# Altium schematic sheet 0229_GPU_ USB & RSVD.SchDoc
size 848 x 558 mm
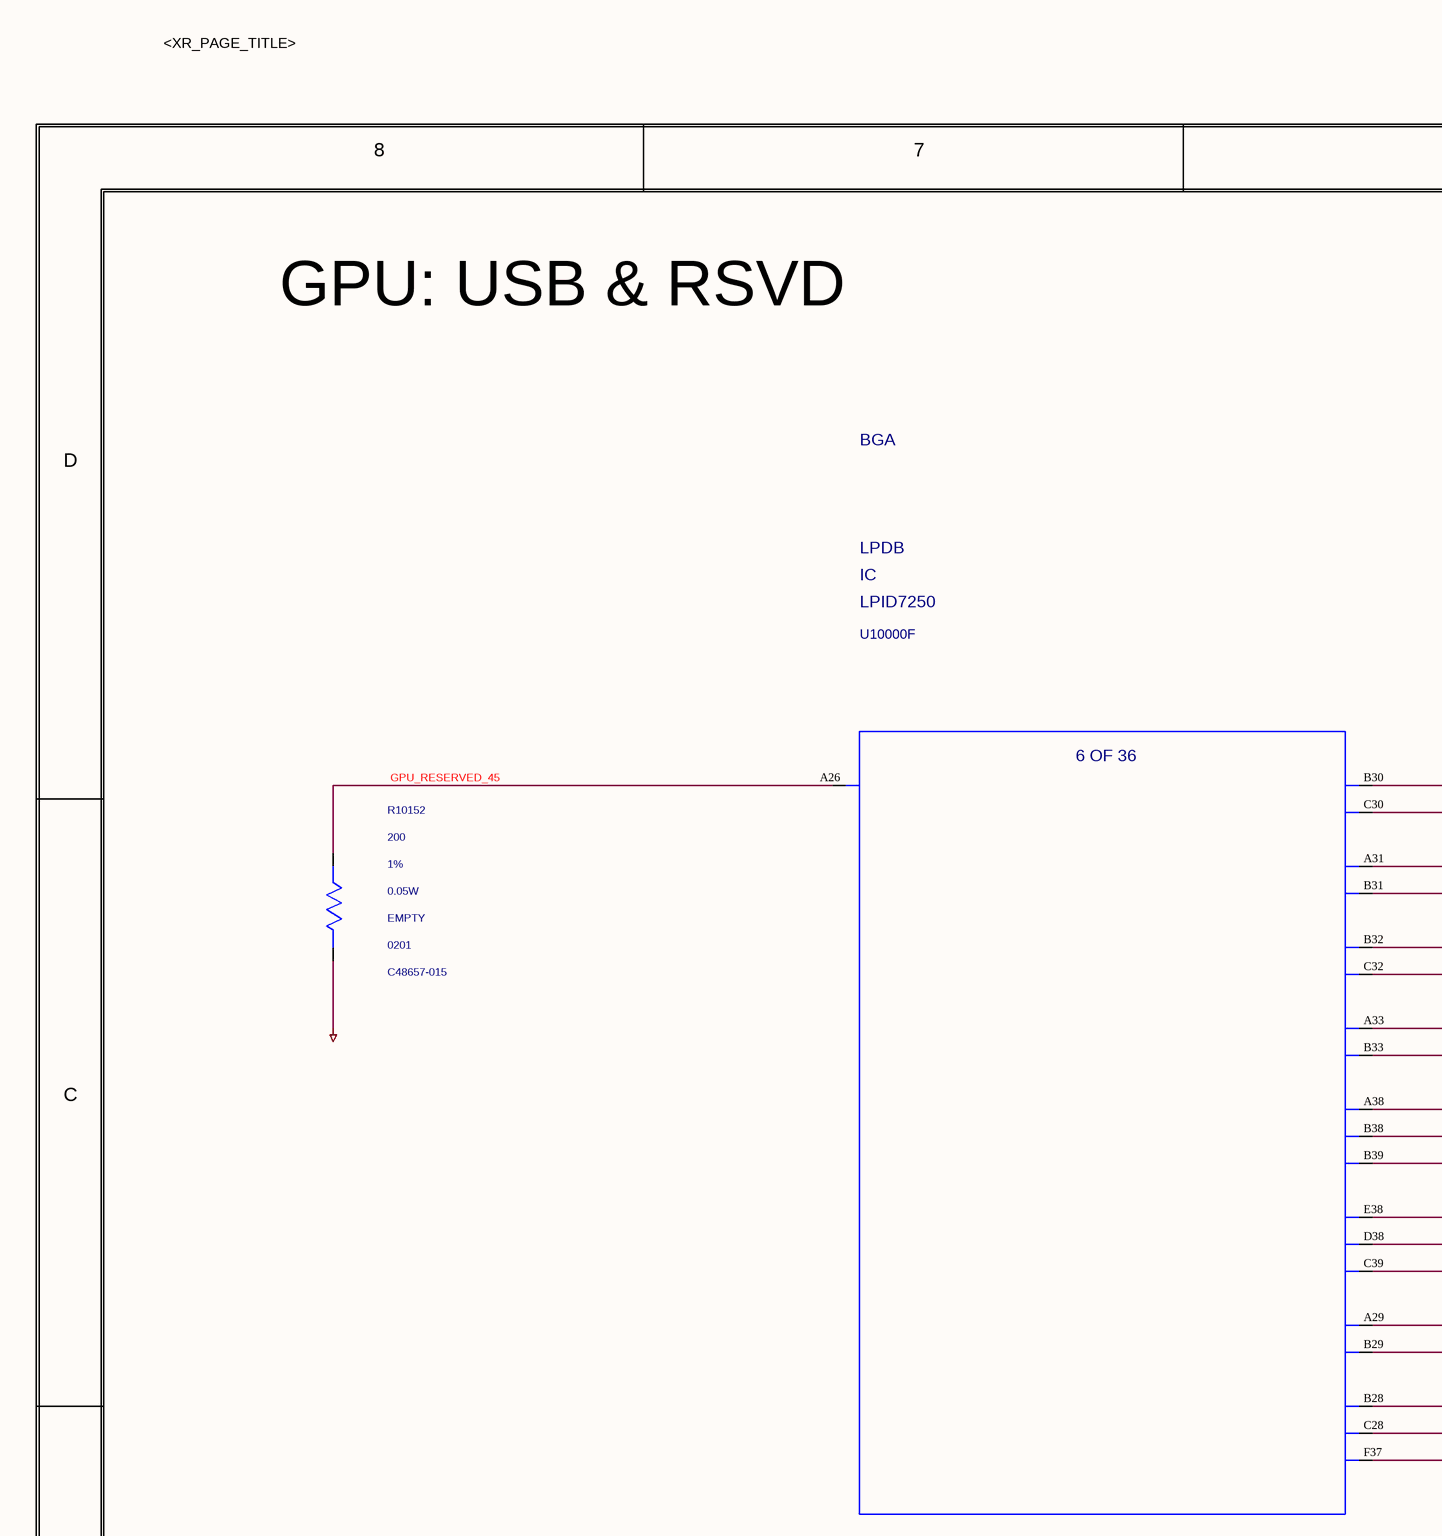
[diagram p0: 0229_GPU_ USB & RSVD.SchDoc, top left]
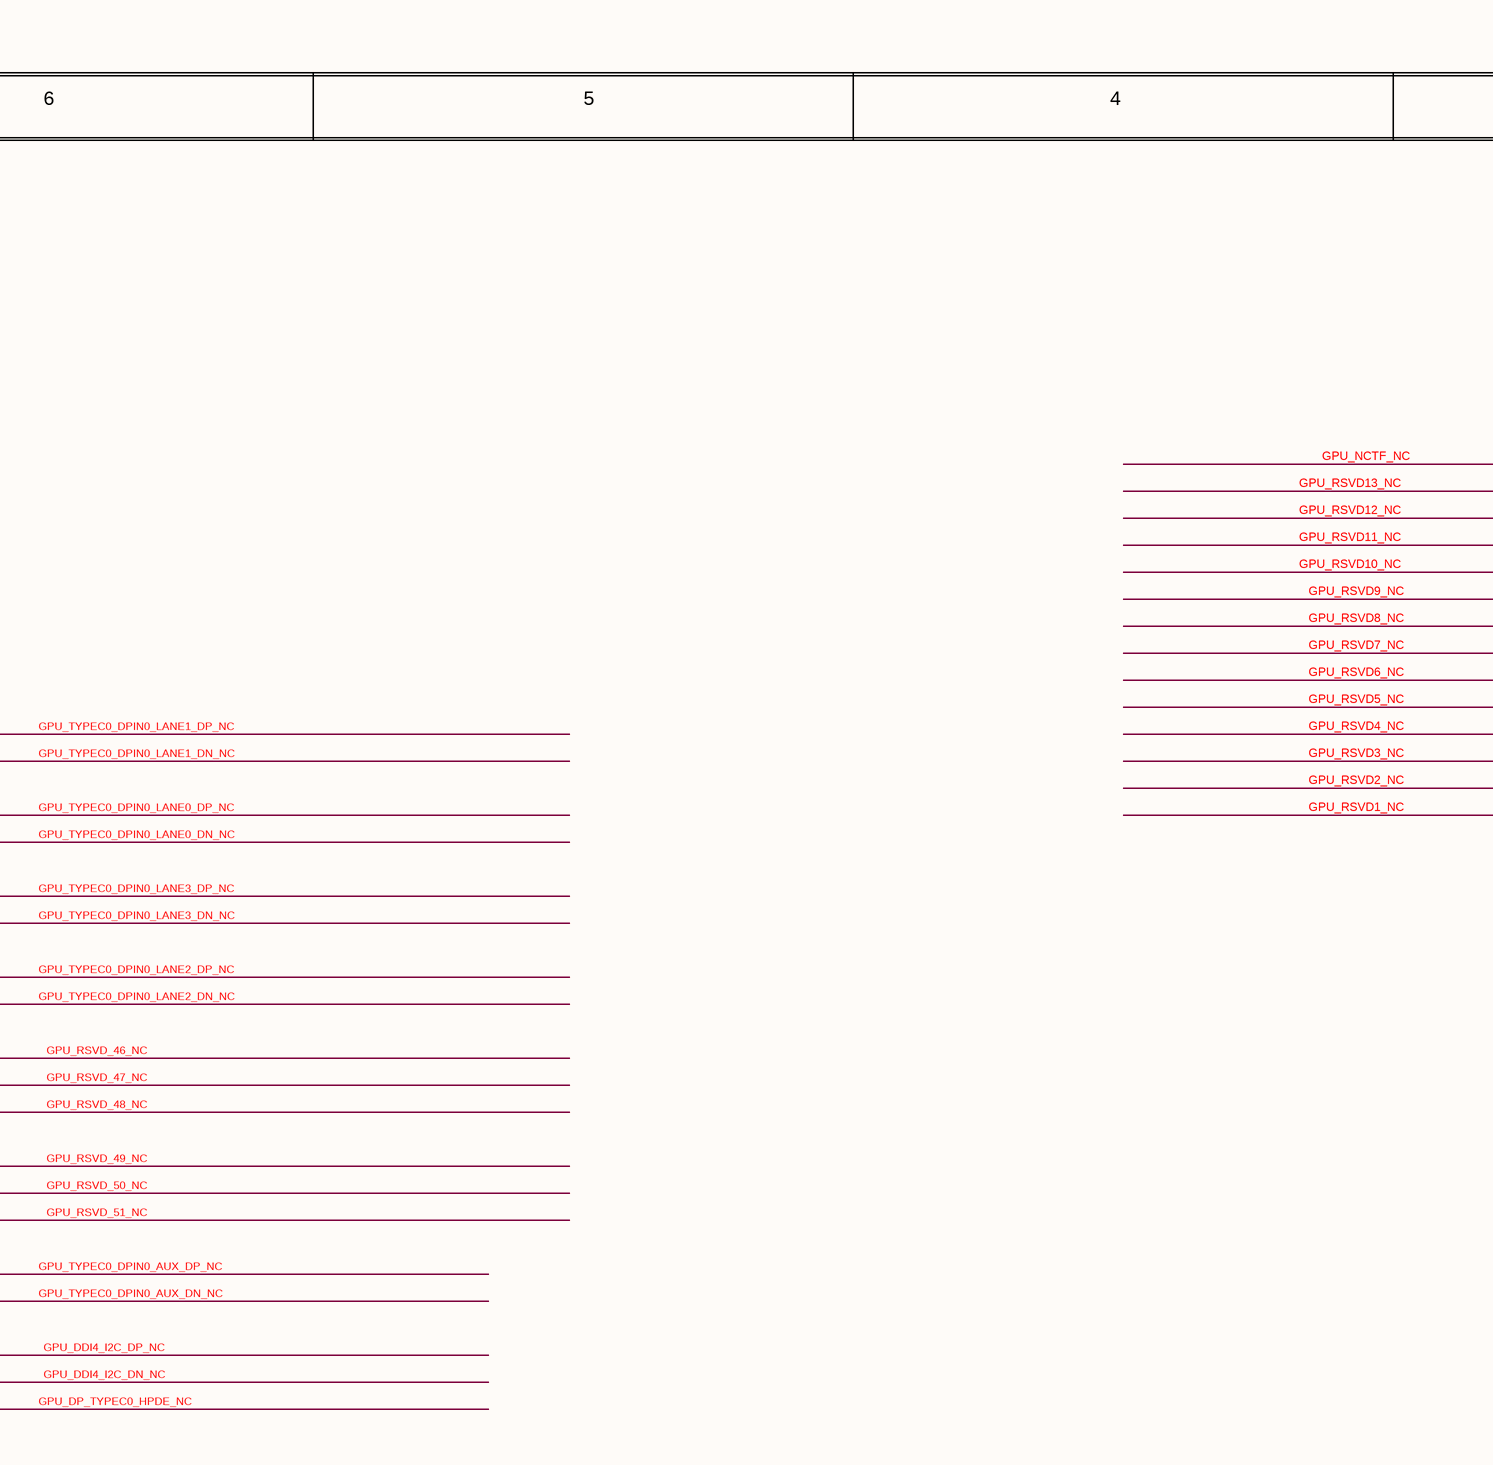
[diagram p1: 0229_GPU_ USB & RSVD.SchDoc, top middle]
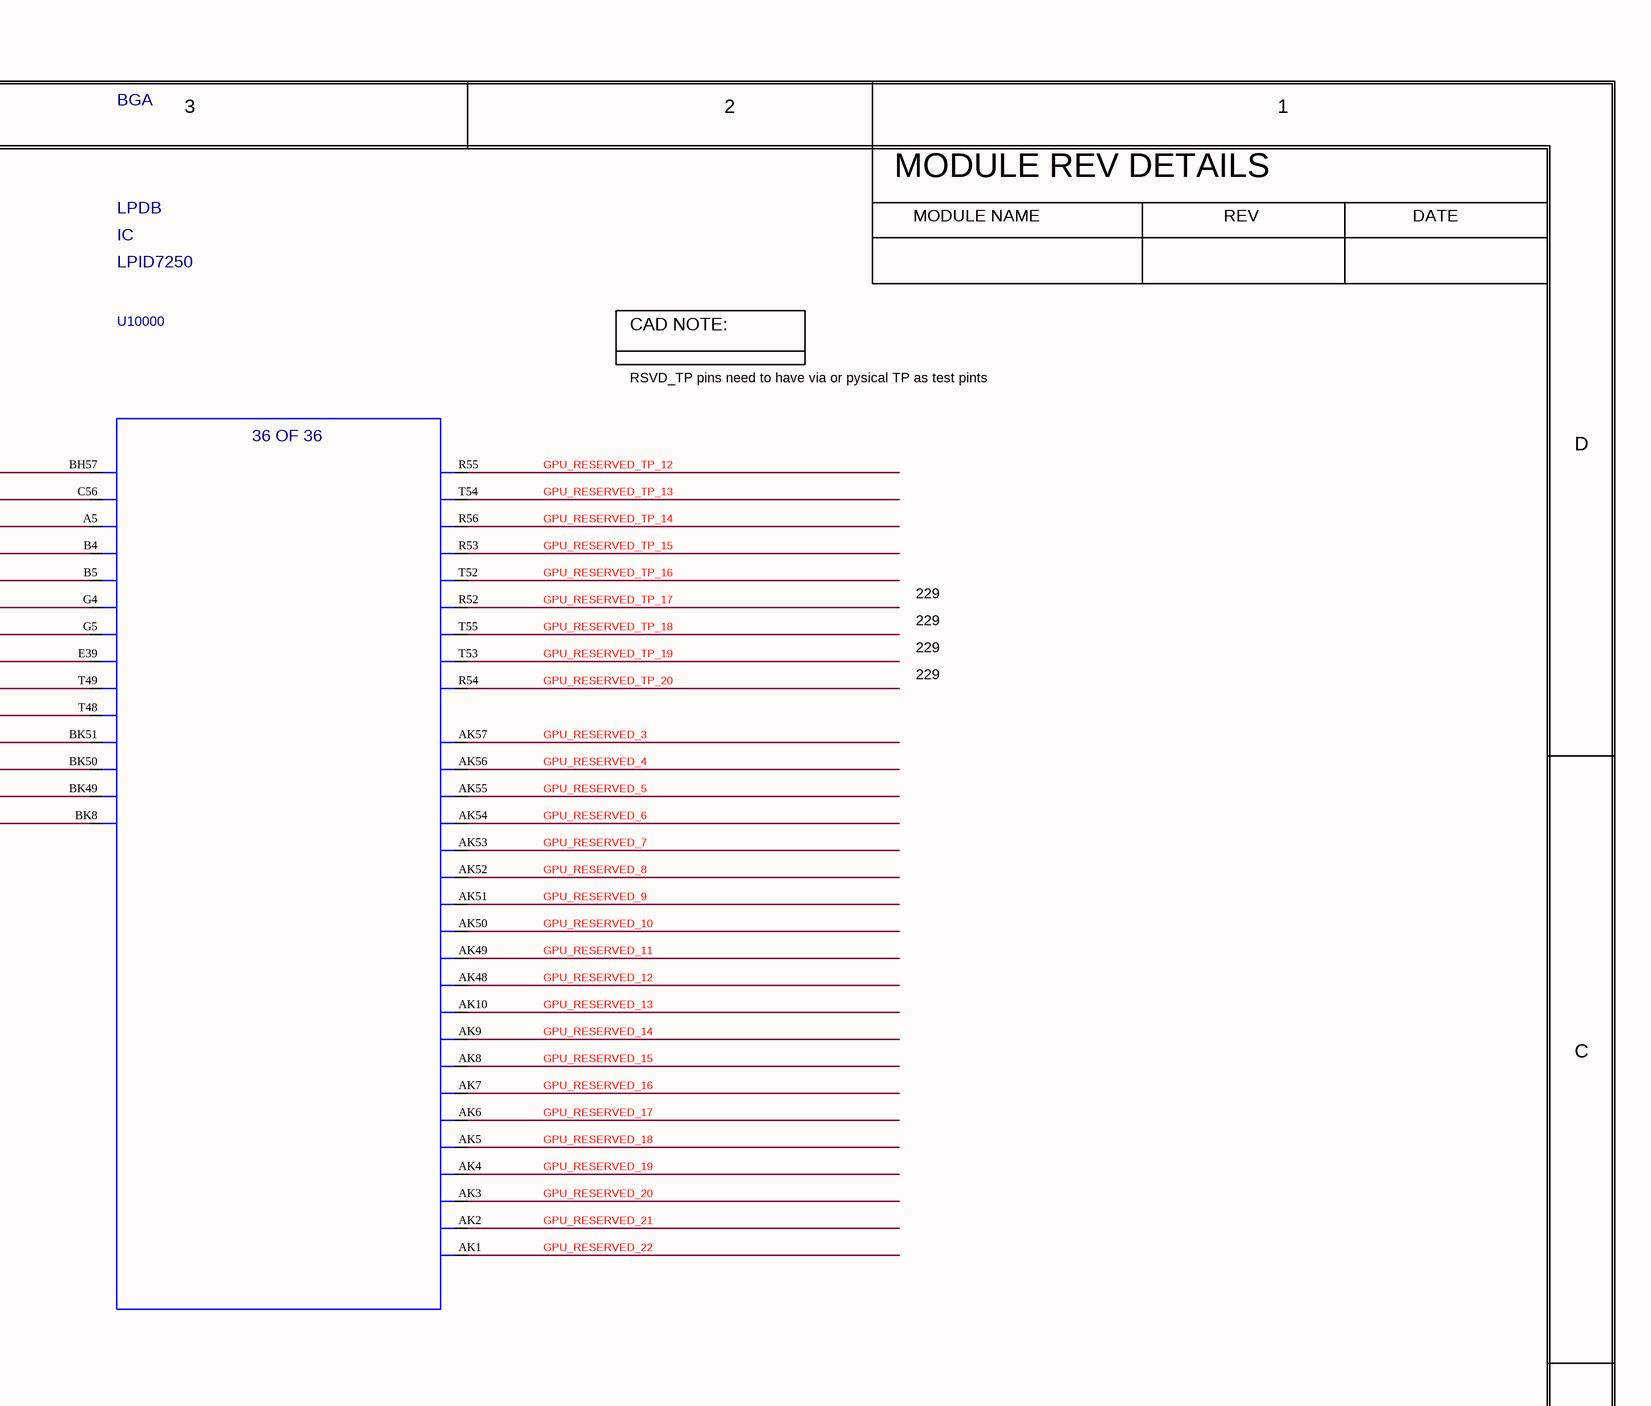
[diagram p2: 0229_GPU_ USB & RSVD.SchDoc, top right]
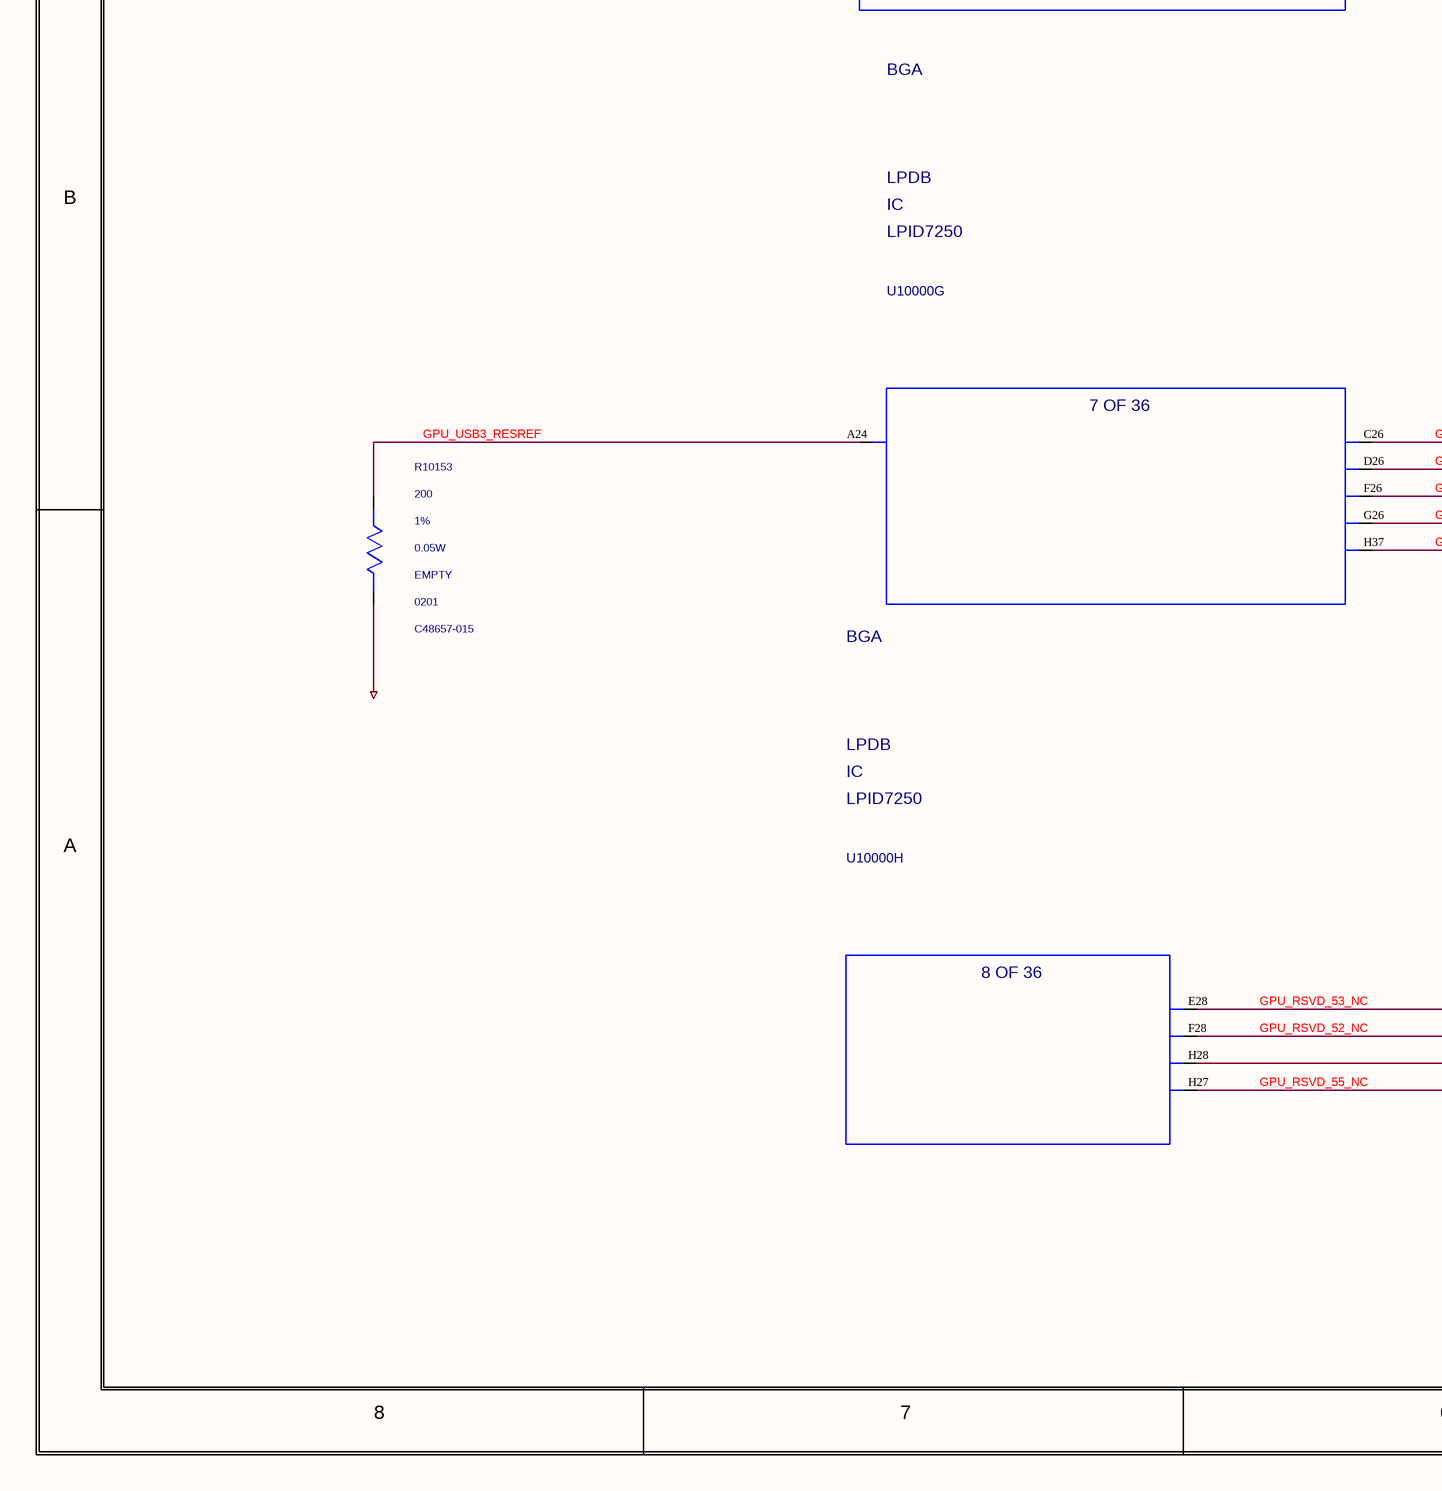
[diagram p3: 0229_GPU_ USB & RSVD.SchDoc, bottom left]
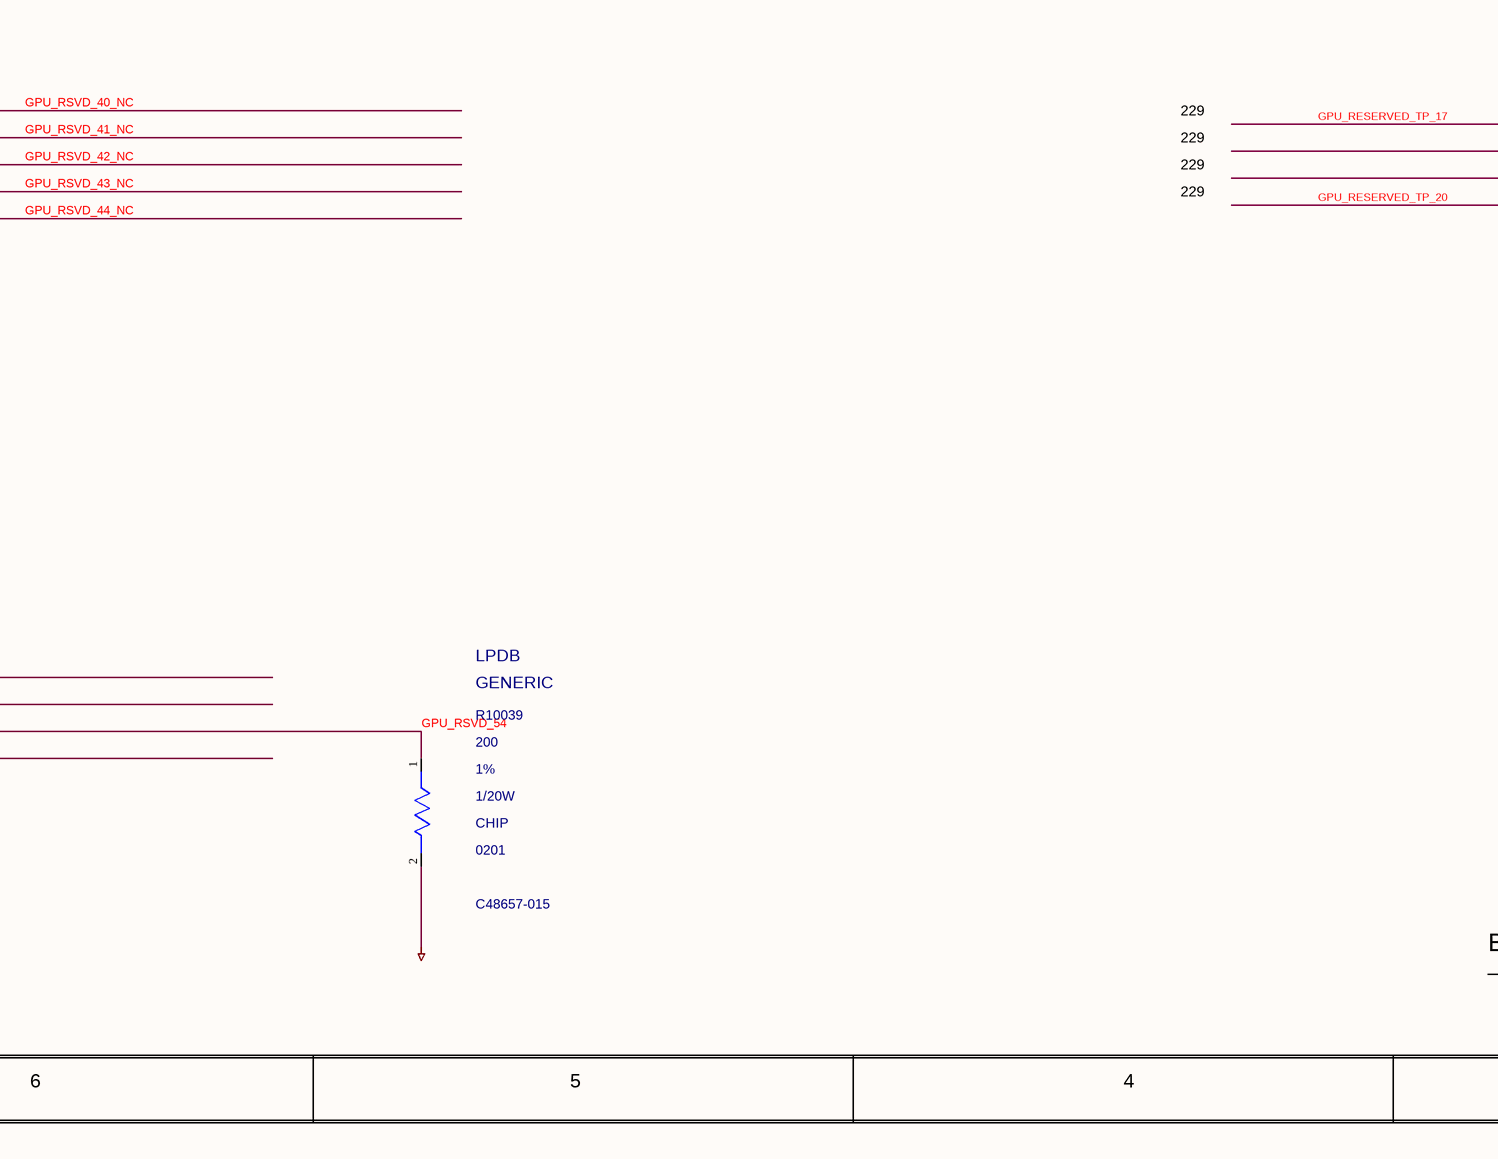
[diagram p4: 0229_GPU_ USB & RSVD.SchDoc, bottom middle]
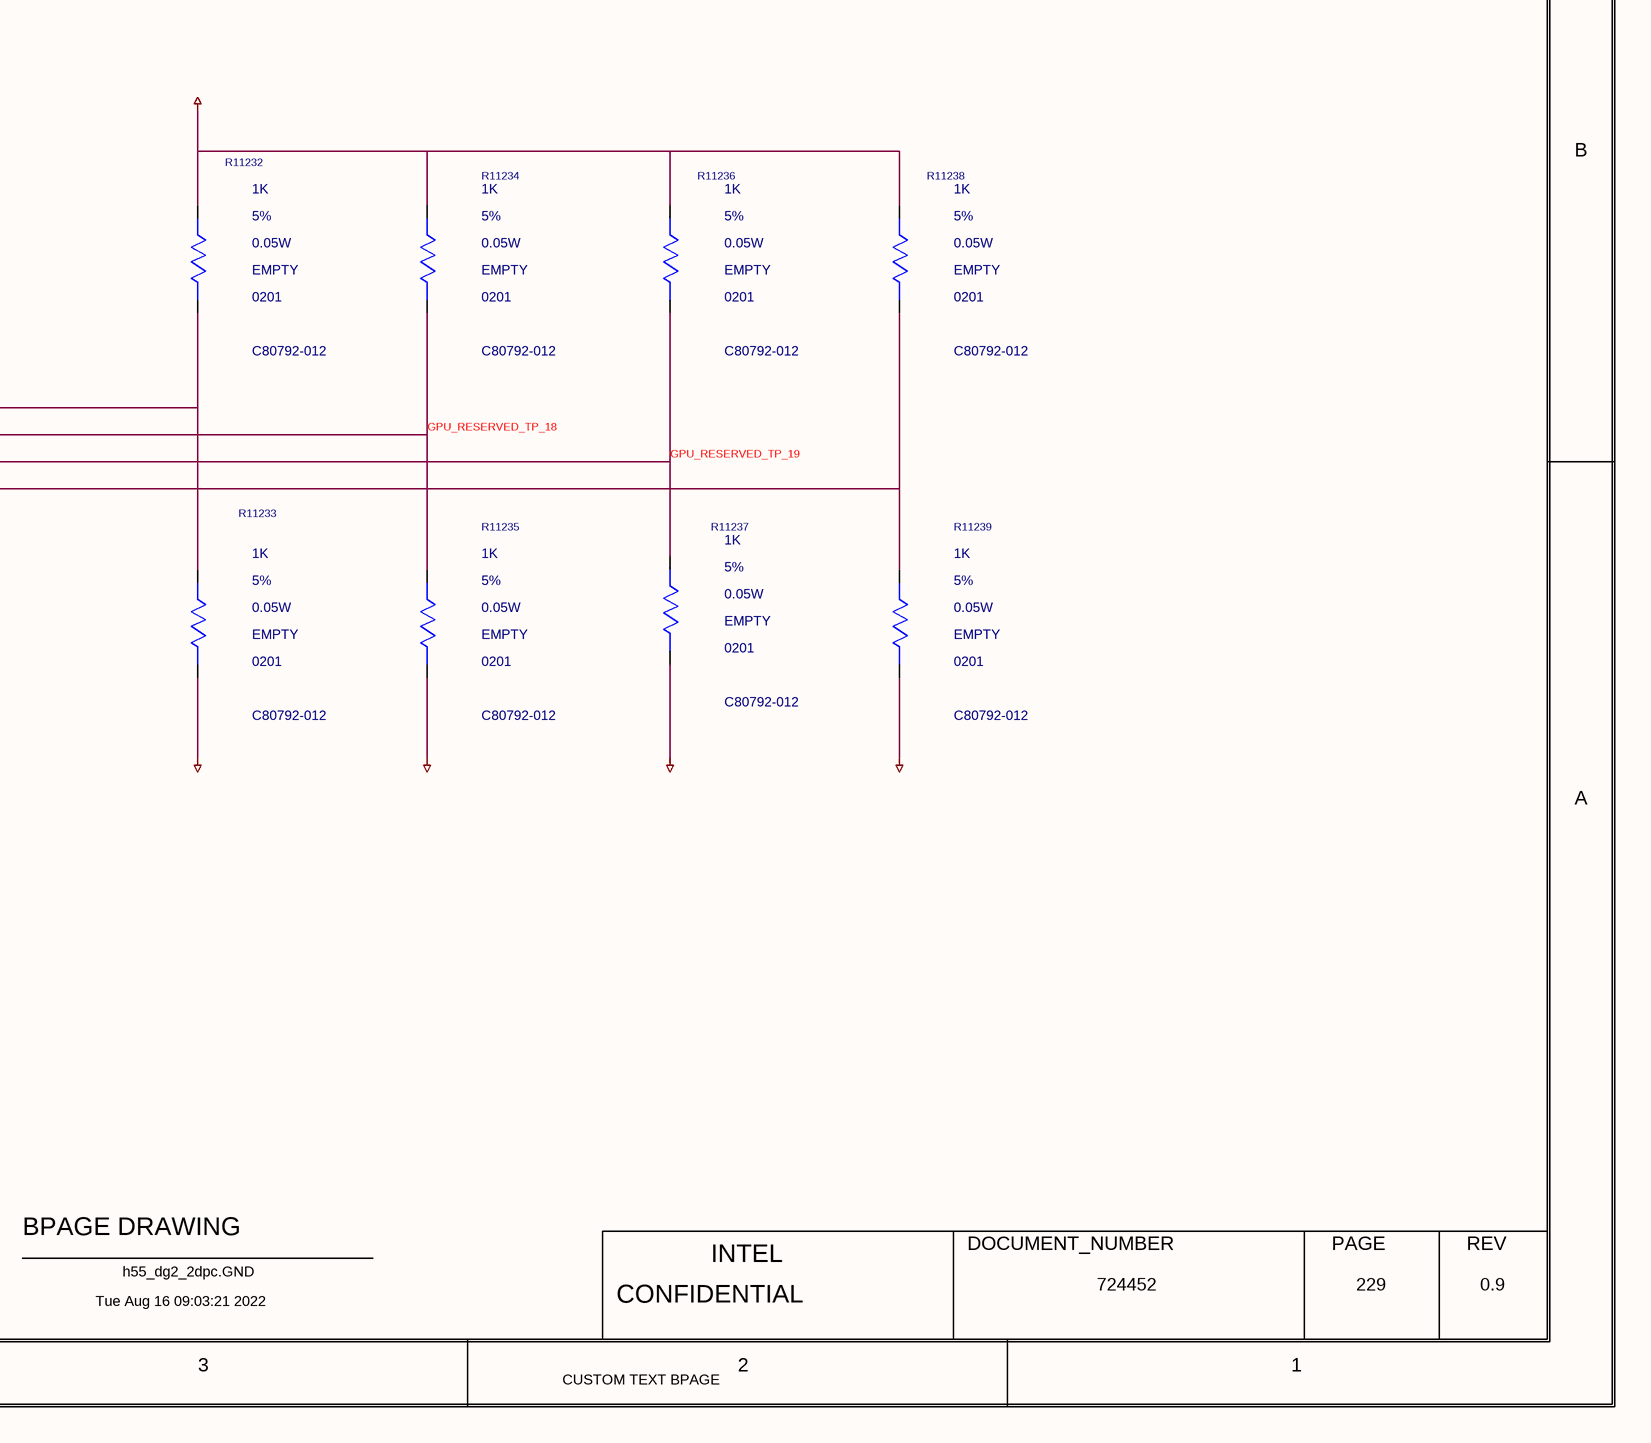
[diagram p5: 0229_GPU_ USB & RSVD.SchDoc, bottom right]

## Parts
R10039  200  MATERIAL: CHIP  PACK_TYPE: 0201  PART_NUMBER: C48657-015  TOLERANCE: 1%  WATTAGE: 1/20W  IP: GENERIC  FP_TECH: LPDB  [SMR0201IA]
R10152  200  MATERIAL: EMPTY  PACK_TYPE: 0201  PART_NUMBER: C48657-015  TOLERANCE: 1%  WATTAGE: 0.05W  [CTK0_SM0201_650X350_MA]
R10153  200  MATERIAL: EMPTY  PACK_TYPE: 0201  PART_NUMBER: C48657-015  TOLERANCE: 1%  WATTAGE: 0.05W  [CTK0_SM0201_650X350_MA]
R11232  1K  MATERIAL: EMPTY  PACK_TYPE: 0201  PART_NUMBER: C80792-012  TOLERANCE: 5%  WATTAGE: 0.05W  [TK0_SM0201_630X330_MC]
R11233  1K  MATERIAL: EMPTY  PACK_TYPE: 0201  PART_NUMBER: C80792-012  TOLERANCE: 5%  WATTAGE: 0.05W  [TK0_SM0201_630X330_MC]
R11234  1K  MATERIAL: EMPTY  PACK_TYPE: 0201  PART_NUMBER: C80792-012  TOLERANCE: 5%  WATTAGE: 0.05W  [TK0_SM0201_630X330_MC]
R11235  1K  MATERIAL: EMPTY  PACK_TYPE: 0201  PART_NUMBER: C80792-012  TOLERANCE: 5%  WATTAGE: 0.05W  [TK0_SM0201_630X330_MC]
R11236  1K  MATERIAL: EMPTY  PACK_TYPE: 0201  PART_NUMBER: C80792-012  TOLERANCE: 5%  WATTAGE: 0.05W  [TK0_SM0201_630X330_MC]
R11237  1K  MATERIAL: EMPTY  PACK_TYPE: 0201  PART_NUMBER: C80792-012  TOLERANCE: 5%  WATTAGE: 0.05W  [TK0_SM0201_630X330_MC]
R11238  1K  MATERIAL: EMPTY  PACK_TYPE: 0201  PART_NUMBER: C80792-012  TOLERANCE: 5%  WATTAGE: 0.05W  [TK0_SM0201_630X330_MC]
R11239  1K  MATERIAL: EMPTY  PACK_TYPE: 0201  PART_NUMBER: C80792-012  TOLERANCE: 5%  WATTAGE: 0.05W  [TK0_SM0201_630X330_MC]
U10000  PART_NUMBER: LPID7250  PACK_TYPE: BGA  MATERIAL: IC  FP_TECH: LPDB  [CLPDB_BGA2660_DG2_SVC_512_LP7250_MA]  (hidden comment: DG2_IP_NB_SKU1_SKU2_SKU3_EXT)  (parts F,G,H,36 of 36)

## Nets
+V1P8S_GPU: R11232.1(A) R11234.1(A) R11236.1(A) R11238.1(A)
GND: R10039.2(B) R10152.2(B) R10153.2(B) R11233.2(B) R11235.2(B) R11237.2(B) R11239.2(B)
GPU_DDI4_I2C_DN_NC: U10000.C28(DDCE_SDA)
GPU_DDI4_I2C_DP_NC: U10000.B28(DDCE_SCL)
GPU_DP_TYPEC0_HPDE_NC: U10000.F37(DP_HPDE#)
GPU_NCTF_NC: U10000.BH57(NCTF)
GPU_RESERVED_3: U10000.AK57(RSVD_3)
GPU_RESERVED_4: U10000.AK56(RSVD_4)
GPU_RESERVED_5: U10000.AK55(RSVD_5)
GPU_RESERVED_6: U10000.AK54(RSVD_6)
GPU_RESERVED_7: U10000.AK53(RSVD_7)
GPU_RESERVED_8: U10000.AK52(RSVD_8)
GPU_RESERVED_9: U10000.AK51(RSVD_9)
GPU_RESERVED_10: U10000.AK50(RSVD_10)
GPU_RESERVED_11: U10000.AK49(RSVD_11)
GPU_RESERVED_12: U10000.AK48(RSVD_12)
GPU_RESERVED_13: U10000.AK10(RSVD_13)
GPU_RESERVED_14: U10000.AK9(RSVD_14)
GPU_RESERVED_15: U10000.AK8(RSVD_15)
GPU_RESERVED_16: U10000.AK7(RSVD_16)
GPU_RESERVED_17: U10000.AK6(RSVD_17)
GPU_RESERVED_18: U10000.AK5(RSVD_18)
GPU_RESERVED_19: U10000.AK4(RSVD_19)
GPU_RESERVED_20: U10000.AK3(RSVD_20)
GPU_RESERVED_21: U10000.AK2(RSVD_21)
GPU_RESERVED_22: U10000.AK1(RSVD_22)
GPU_RESERVED_45: R10152.1(A) U10000.A26(RSVD_45)
GPU_RESERVED_TP_12: U10000.R55(RSVD_TP_12)
GPU_RESERVED_TP_13: U10000.T54(RSVD_TP_13)
GPU_RESERVED_TP_14: U10000.R56(RSVD_TP_14)
GPU_RESERVED_TP_15: U10000.R53(RSVD_TP_15)
GPU_RESERVED_TP_16: U10000.T52(RSVD_TP_16)
GPU_RESERVED_TP_17: R11232.2(B) R11233.1(A) U10000.R52(RSVD_TP_17)
GPU_RESERVED_TP_18: R11234.2(B) R11235.1(A) U10000.T55(RSVD_TP_18)
GPU_RESERVED_TP_19: R11236.2(B) R11237.1(A) U10000.T53(RSVD_TP_19)
GPU_RESERVED_TP_20: R11238.2(B) R11239.1(A) U10000.R54(RSVD_TP_20)
GPU_RSVD1_NC: U10000.BK8(RSVD_TP_11)
GPU_RSVD2_NC: U10000.BK49(RSVD_TP_10)
GPU_RSVD3_NC: U10000.BK50(RSVD_TP_9)
GPU_RSVD4_NC: U10000.BK51(RSVD_TP_8)
GPU_RSVD5_NC: U10000.T48(RSVD_TP_7)
GPU_RSVD6_NC: U10000.T49(RSVD_TP_6)
GPU_RSVD7_NC: U10000.E39(RSVD_TP_5)
GPU_RSVD8_NC: U10000.G5(RSVD_TP_4)
GPU_RSVD9_NC: U10000.G4(RSVD_TP_3)
GPU_RSVD10_NC: U10000.B5(RSVD_TP_2)
GPU_RSVD11_NC: U10000.B4(RSVD_TP_1)
GPU_RSVD12_NC: U10000.A5(RSVD_2)
GPU_RSVD13_NC: U10000.C56(RSVD_1)
GPU_RSVD_40_NC: U10000.C26(RSVD_40)
GPU_RSVD_41_NC: U10000.D26(RSVD_41)
GPU_RSVD_42_NC: U10000.F26(RSVD_42)
GPU_RSVD_43_NC: U10000.G26(RSVD_43)
GPU_RSVD_44_NC: U10000.H37(RSVD_44)
GPU_RSVD_46_NC: U10000.A38(RSVD_46)
GPU_RSVD_47_NC: U10000.B38(RSVD_47)
GPU_RSVD_48_NC: U10000.B39(RSVD_48)
GPU_RSVD_49_NC: U10000.E38(RSVD_49)
GPU_RSVD_50_NC: U10000.D38(RSVD_50)
GPU_RSVD_51_NC: U10000.C39(RSVD_51)
GPU_RSVD_52_NC: U10000.F28(RSVD_52)
GPU_RSVD_53_NC: U10000.E28(RSVD_53)
GPU_RSVD_54: R10039.1(A) U10000.H28(RSVD_54)
GPU_RSVD_55_NC: U10000.H27(RSVD_55)
GPU_TYPEC0_DPIN0_AUX_DN_NC: U10000.B29(DDIE_AUX_N)
GPU_TYPEC0_DPIN0_AUX_DP_NC: U10000.A29(DDIE_AUX_P)
GPU_TYPEC0_DPIN0_LANE0_DN_NC: U10000.B31(DDIE_TXN0)
GPU_TYPEC0_DPIN0_LANE0_DP_NC: U10000.A31(DDIE_TXP0)
GPU_TYPEC0_DPIN0_LANE1_DN_NC: U10000.C30(DDIE_TXN1)
GPU_TYPEC0_DPIN0_LANE1_DP_NC: U10000.B30(DDIE_TXP1)
GPU_TYPEC0_DPIN0_LANE2_DN_NC: U10000.B33(DDIE_TXN2)
GPU_TYPEC0_DPIN0_LANE2_DP_NC: U10000.A33(DDIE_TXP2)
GPU_TYPEC0_DPIN0_LANE3_DN_NC: U10000.C32(DDIE_TXN3)
GPU_TYPEC0_DPIN0_LANE3_DP_NC: U10000.B32(DDIE_TXP3)
GPU_USB3_RESREF: R10153.1(A) U10000.A24(RSVD_39)

## Notes on the sheet
- <XR_PAGE_TITLE>
- 8
- 7
- 6
- 5
- 4
- 3
- 2
- 1
- MODULE REV DETAILS
- GPU: USB & RSVD
- MODULE NAME
- REV
- DATE
- CAD NOTE:
- RSVD_TP pins need to have via or pysical TP as test pints
- D
- 229
- C
- B
- A
- BPAGE DRAWING
- INTEL
- DOCUMENT_NUMBER
- PAGE
- Tue Aug 16 09:03:21 2022
- h55_dg2_2dpc.GND
- CONFIDENTIAL
- 724452
- 0.9
- CUSTOM TEXT BPAGE
- (in symbol DG2_IP_NB_SKU1_SKU2_SKU3_EXT, part F) 6 OF 36
- (in symbol DG2_IP_NB_SKU1_SKU2_SKU3_EXT, part G) 7 OF 36
- (in symbol DG2_IP_NB_SKU1_SKU2_SKU3_EXT, part H) 8 OF 36
- (in symbol DG2_IP_NB_SKU1_SKU2_SKU3_EXT, part 36) 36 OF 36

## Library data of the parts
R10039 = RES: CDS_PHYS_PART_NAME: RES_0201-C48657-015,CHIP,200,1%,1/20W,LPDB,GENERIC; OriginalSymbolOrigin: (-25,75); XY: (-1050,-950); VER: 2; ROT: 0; PHYS_PAGE: 229; LOCATION: R10039; DRAWING: @RVP1_ADL_SB_ADP_S_DDR5_SODIMM_2DPC_LIB.H55_DG2_2DPC(SCH_1):PAGE400; CDS_LIB: discrete; PCB Footprint: SMR0201IA; CHIPS_PART_NAME: RES; CDS_PART_NAME: RES_0201-C48657-015,CHIP,200,1%,1/20W,LPDB,GENERIC; CDS_LOCATION: R10039
R10152 = C_RES: CDS_PHYS_PART_NAME: C_RES_0201-C48657-015,EMPTY,200,1%,0.05W,TK0,GENERIC; CDS_LMAN_SYM_OUTLINE: -50,50,50,-50; FP_TECH: TK0; IP: GENERIC; ROOM: NONE; OriginalSymbolOrigin: (-25,75); XY: (-3825,2275); VER: 2; ROT: 0; PHYS_PAGE: 229; LOCATION: R10152; DRAWING: @RVP1_ADL_SB_ADP_S_DDR5_SODIMM_2DPC_LIB.H55_DG2_2DPC(SCH_1):PAGE400; CDS_LIB: c_discrete; VARIANT: ?; PCB Footprint: CTK0_SM0201_650X350_MA; CHIPS_PART_NAME: C_RES; CDS_PART_NAME: C_RES_0201-C48657-015,EMPTY,200,1%,0.05W,TK0,GENERIC; CDS_LOCATION: R10152
R10153 = C_RES: CDS_PHYS_PART_NAME: C_RES_0201-C48657-015,EMPTY,200,1%,0.05W,TK0,GENERIC; CDS_LMAN_SYM_OUTLINE: -50,50,50,-50; FP_TECH: TK0; IP: GENERIC; ROOM: NONE; OriginalSymbolOrigin: (-25,75); XY: (-3750,150); VER: 2; ROT: 0; PHYS_PAGE: 229; LOCATION: R10153; DRAWING: @RVP1_ADL_SB_ADP_S_DDR5_SODIMM_2DPC_LIB.H55_DG2_2DPC(SCH_1):PAGE400; CDS_LIB: c_discrete; VARIANT: ?; PCB Footprint: CTK0_SM0201_650X350_MA; CHIPS_PART_NAME: C_RES; CDS_PART_NAME: C_RES_0201-C48657-015,EMPTY,200,1%,0.05W,TK0,GENERIC; CDS_LOCATION: R10153
R11232 = RES_2: CDS_PHYS_PART_NAME: RES_2_0201-C80792-012,EMPTY,1K,5%,0.05W,TK0,GENERIC; BOM_USE: STUFF; CDS_LMAN_SYM_OUTLINE: -50,50,50,-50; FP_TECH: TK0; IP: GENERIC; ROOM: NONE; OriginalSymbolOrigin: (-25,75); XY: (1250,600); VER: 2; ROT: 0; PHYS_PAGE: 229; LOCATION: R11232; DRAWING: @RVP1_ADL_SB_ADP_S_DDR5_SODIMM_2DPC_LIB.H55_DG2_2DPC(SCH_1):PAGE400; CDS_LIB: discrete_2; VARIANT: ?; PCB Footprint: TK0_SM0201_630X330_MC; CHIPS_PART_NAME: RES_2; CDS_PART_NAME: RES_2_0201-C80792-012,EMPTY,1K,5%,0.05W,TK0,GENERIC; CDS_LOCATION: R11232
R11233 = RES_2: CDS_PHYS_PART_NAME: RES_2_0201-C80792-012,EMPTY,1K,5%,0.05W,TK0,GENERIC; BOM_USE: STUFF; CDS_LMAN_SYM_OUTLINE: -50,50,50,-50; FP_TECH: TK0; IP: GENERIC; ROOM: NONE; OriginalSymbolOrigin: (-25,75); XY: (1250,-75); VER: 2; ROT: 0; PHYS_PAGE: 229; LOCATION: R11233; DRAWING: @RVP1_ADL_SB_ADP_S_DDR5_SODIMM_2DPC_LIB.H55_DG2_2DPC(SCH_1):PAGE400; CDS_LIB: discrete_2; VARIANT: ?; PCB Footprint: TK0_SM0201_630X330_MC; CHIPS_PART_NAME: RES_2; CDS_PART_NAME: RES_2_0201-C80792-012,EMPTY,1K,5%,0.05W,TK0,GENERIC; CDS_LOCATION: R11233
R11234 = RES_2: CDS_PHYS_PART_NAME: RES_2_0201-C80792-012,EMPTY,1K,5%,0.05W,TK0,GENERIC; BOM_USE: STUFF; CDS_LMAN_SYM_OUTLINE: -50,50,50,-50; FP_TECH: TK0; IP: GENERIC; ROOM: NONE; OriginalSymbolOrigin: (-25,75); XY: (1675,600); VER: 2; ROT: 0; PHYS_PAGE: 229; LOCATION: R11234; DRAWING: @RVP1_ADL_SB_ADP_S_DDR5_SODIMM_2DPC_LIB.H55_DG2_2DPC(SCH_1):PAGE400; CDS_LIB: discrete_2; VARIANT: ?; PCB Footprint: TK0_SM0201_630X330_MC; CHIPS_PART_NAME: RES_2; CDS_PART_NAME: RES_2_0201-C80792-012,EMPTY,1K,5%,0.05W,TK0,GENERIC; CDS_LOCATION: R11234
R11235 = RES_2: CDS_PHYS_PART_NAME: RES_2_0201-C80792-012,EMPTY,1K,5%,0.05W,TK0,GENERIC; BOM_USE: STUFF; CDS_LMAN_SYM_OUTLINE: -50,50,50,-50; FP_TECH: TK0; IP: GENERIC; ROOM: NONE; OriginalSymbolOrigin: (-25,75); XY: (1675,-75); VER: 2; ROT: 0; PHYS_PAGE: 229; LOCATION: R11235; DRAWING: @RVP1_ADL_SB_ADP_S_DDR5_SODIMM_2DPC_LIB.H55_DG2_2DPC(SCH_1):PAGE400; CDS_LIB: discrete_2; VARIANT: ?; PCB Footprint: TK0_SM0201_630X330_MC; CHIPS_PART_NAME: RES_2; CDS_PART_NAME: RES_2_0201-C80792-012,EMPTY,1K,5%,0.05W,TK0,GENERIC; CDS_LOCATION: R11235
R11236 = RES_2: CDS_PHYS_PART_NAME: RES_2_0201-C80792-012,EMPTY,1K,5%,0.05W,TK0,GENERIC; BOM_USE: STUFF; CDS_LMAN_SYM_OUTLINE: -50,50,50,-50; FP_TECH: TK0; IP: GENERIC; ROOM: NONE; OriginalSymbolOrigin: (-25,75); XY: (2125,600); VER: 2; ROT: 0; PHYS_PAGE: 229; LOCATION: R11236; DRAWING: @RVP1_ADL_SB_ADP_S_DDR5_SODIMM_2DPC_LIB.H55_DG2_2DPC(SCH_1):PAGE400; CDS_LIB: discrete_2; VARIANT: ?; PCB Footprint: TK0_SM0201_630X330_MC; CHIPS_PART_NAME: RES_2; CDS_PART_NAME: RES_2_0201-C80792-012,EMPTY,1K,5%,0.05W,TK0,GENERIC; CDS_LOCATION: R11236
R11237 = RES_2: CDS_PHYS_PART_NAME: RES_2_0201-C80792-012,EMPTY,1K,5%,0.05W,TK0,GENERIC; BOM_USE: STUFF; CDS_LMAN_SYM_OUTLINE: -50,50,50,-50; FP_TECH: TK0; IP: GENERIC; ROOM: NONE; OriginalSymbolOrigin: (-25,75); XY: (2125,-50); VER: 2; ROT: 0; PHYS_PAGE: 229; LOCATION: R11237; DRAWING: @RVP1_ADL_SB_ADP_S_DDR5_SODIMM_2DPC_LIB.H55_DG2_2DPC(SCH_1):PAGE400; CDS_LIB: discrete_2; VARIANT: ?; PCB Footprint: TK0_SM0201_630X330_MC; CHIPS_PART_NAME: RES_2; CDS_PART_NAME: RES_2_0201-C80792-012,EMPTY,1K,5%,0.05W,TK0,GENERIC; CDS_LOCATION: R11237
R11238 = RES_2: CDS_PHYS_PART_NAME: RES_2_0201-C80792-012,EMPTY,1K,5%,0.05W,TK0,GENERIC; BOM_USE: STUFF; CDS_LMAN_SYM_OUTLINE: -50,50,50,-50; FP_TECH: TK0; IP: GENERIC; ROOM: NONE; OriginalSymbolOrigin: (-25,75); XY: (2550,600); VER: 2; ROT: 0; PHYS_PAGE: 229; LOCATION: R11238; DRAWING: @RVP1_ADL_SB_ADP_S_DDR5_SODIMM_2DPC_LIB.H55_DG2_2DPC(SCH_1):PAGE400; CDS_LIB: discrete_2; VARIANT: ?; PCB Footprint: TK0_SM0201_630X330_MC; CHIPS_PART_NAME: RES_2; CDS_PART_NAME: RES_2_0201-C80792-012,EMPTY,1K,5%,0.05W,TK0,GENERIC; CDS_LOCATION: R11238
R11239 = RES_2: CDS_PHYS_PART_NAME: RES_2_0201-C80792-012,EMPTY,1K,5%,0.05W,TK0,GENERIC; BOM_USE: STUFF; CDS_LMAN_SYM_OUTLINE: -50,50,50,-50; FP_TECH: TK0; IP: GENERIC; ROOM: NONE; OriginalSymbolOrigin: (-25,75); XY: (2550,-75); VER: 2; ROT: 0; PHYS_PAGE: 229; LOCATION: R11239; DRAWING: @RVP1_ADL_SB_ADP_S_DDR5_SODIMM_2DPC_LIB.H55_DG2_2DPC(SCH_1):PAGE400; CDS_LIB: discrete_2; VARIANT: ?; PCB Footprint: TK0_SM0201_630X330_MC; CHIPS_PART_NAME: RES_2; CDS_PART_NAME: RES_2_0201-C80792-012,EMPTY,1K,5%,0.05W,TK0,GENERIC; CDS_LOCATION: R11239
U10000 = DG2_IP_NB_SKU1_SKU2_SKU3_EXT: MANUF: INTEL CORP; CDS_PHYS_PART_NAME: DG2_IP_NB_SKU1_SKU2_SKU3_EXT_BGA-LPID7250,IC,DG2_IP_NB_SKU1_SKUA; CDS_LMAN_SYM_OUTLINE: -300,850,300,-800; OriginalSymbolOrigin: (-325,850); CaptureCellPackProp: DG2_IP_NB_SKU1_SKU2_SKU3_EXTF; XY: (-2400,1850); VER: 6; ROT: 0; PHYS_PAGE: 229; MFG_PN: NONE; LOCATION: U10000; DRAWING: @RVP1_ADL_SB_ADP_S_DDR5_SODIMM_2DPC_LIB.H55_DG2_2DPC(SCH_1):PAGE400; CDS_LIB: rvp1_adl_sb_adp_s_ddr5_sodimm_2dpc_lib; BMAP_REV: 1.0; PCB Footprint: CLPDB_BGA2660_DG2_SVC_512_LP7250_MA; SEC_TYPE: BGA; CHIPS_PART_NAME: DG2_IP_NB_SKU1_SKU2_SKU3_EXT; CDS_PART_NAME: DG2_IP_NB_SKU1_SKU2_SKU3_EXT_BGA-LPID7250,IC,DG2_IP_NB_SKU1_SKUA; CDS_LOCATION: U10000